# EasyEDA Pro project Archive.eprj, board ALU4.0 (continued)
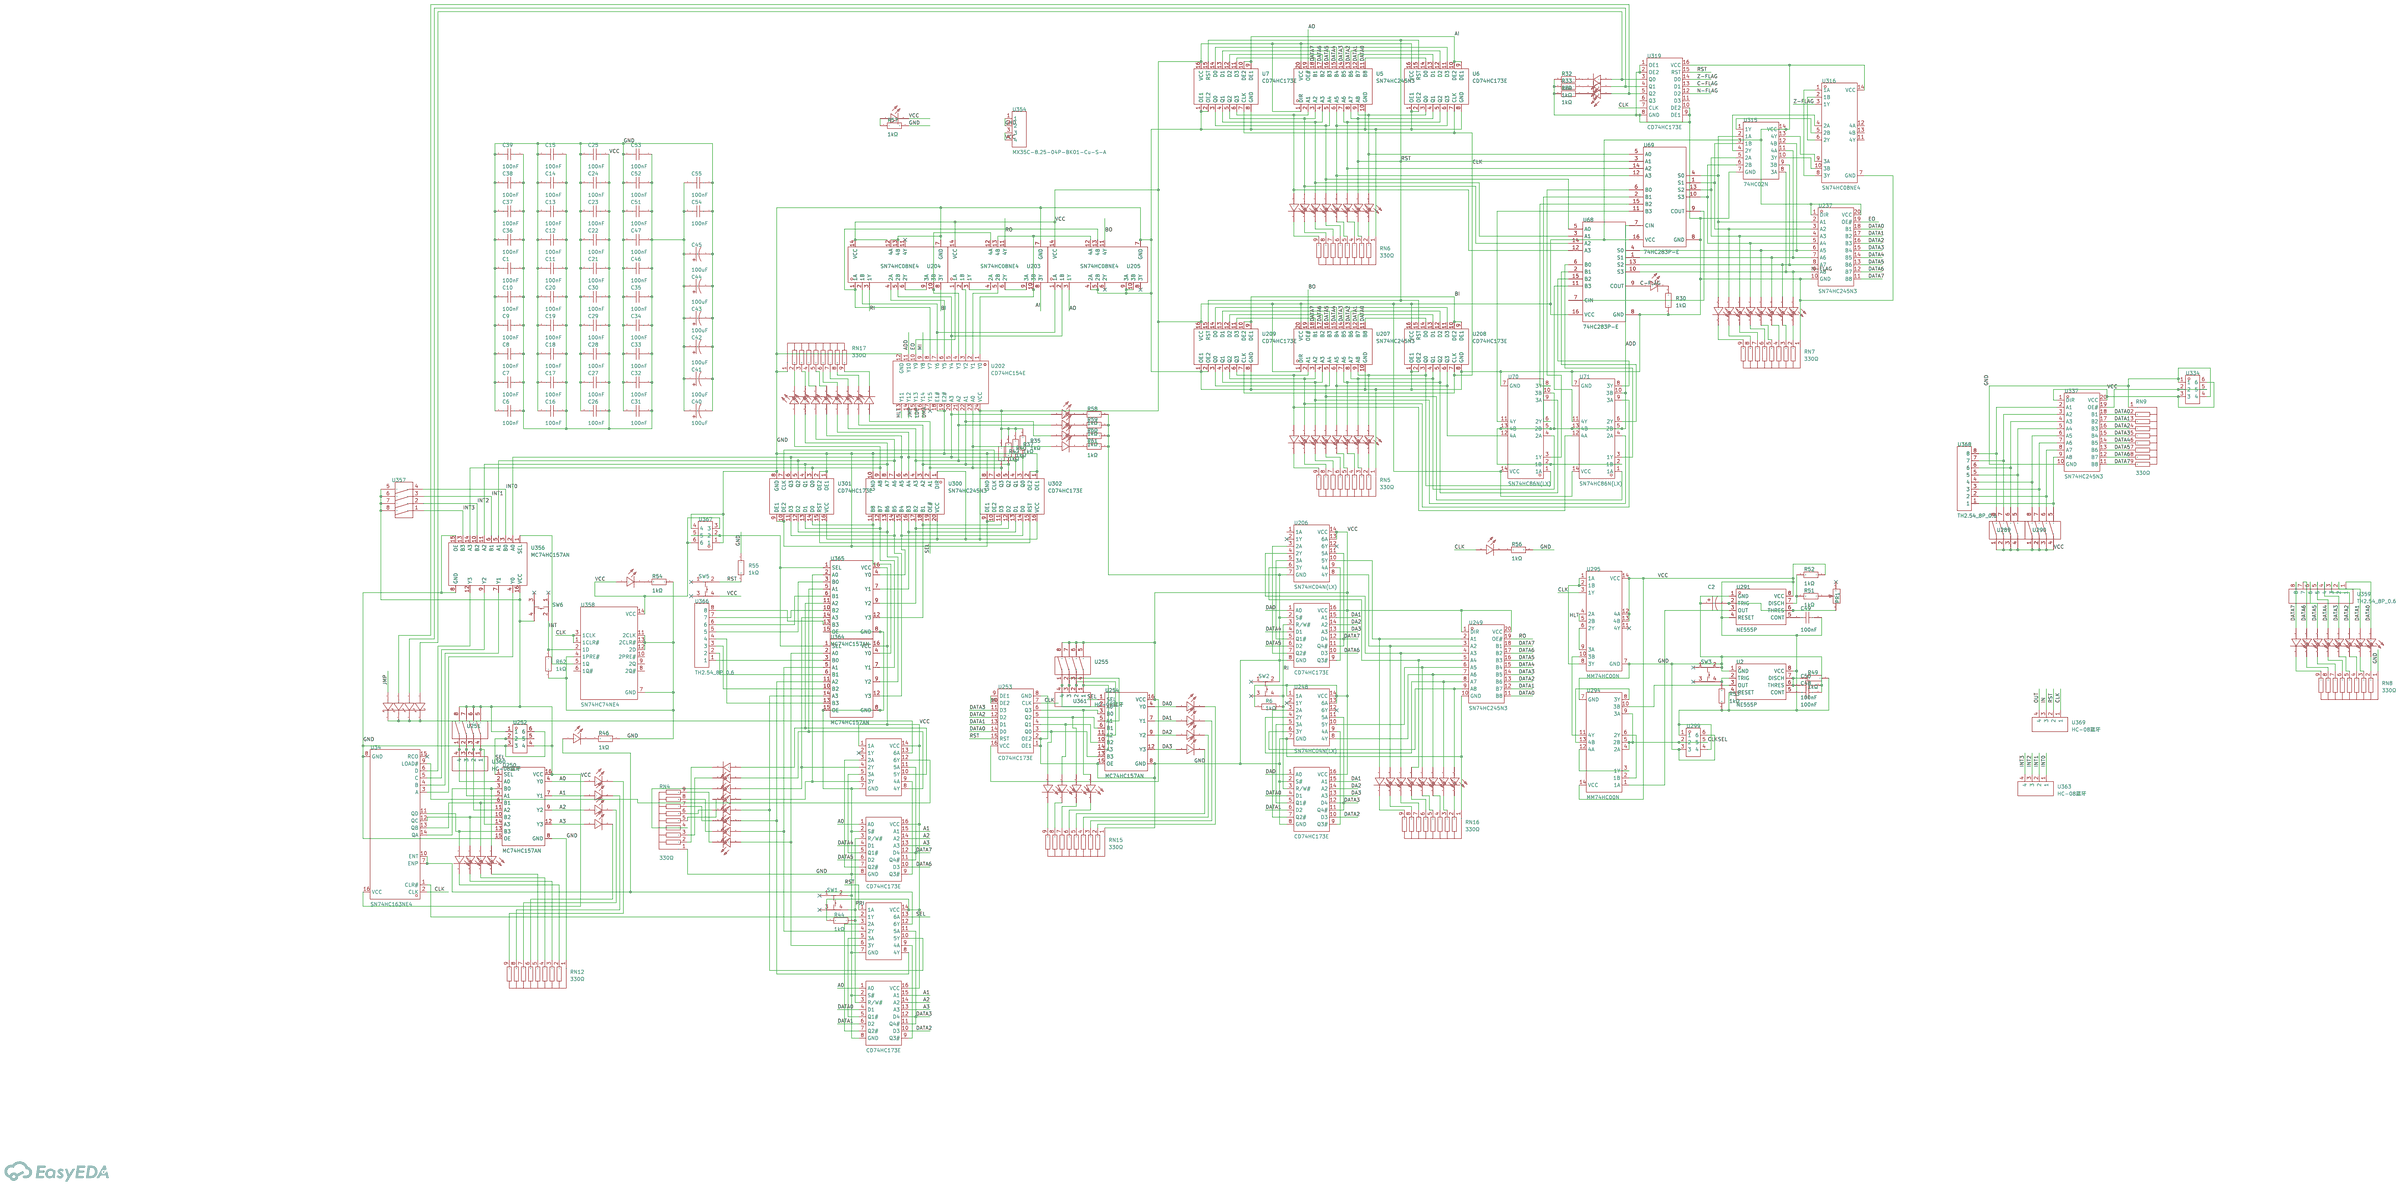
[diagram p0: schematic sheet]
## Footprints (pads in the part's own frame, mm; a bottom-side part is the same pattern mirrored in y, then rotated) (continued)
Pad_e1047
  round 1.524 hole 0.914: 1(0,0)
Pad_e1048
  round 1.524 hole 0.914: 1(0,0)
Pad_e1049
  round 1.524 hole 0.914: 1(0,0)
Pad_e1050
  round 1.524 hole 0.914: 1(0,0)
Pad_e1051
  round 1.524 hole 0.914: 1(0,0)
Pad_e1052
  round 1.524 hole 0.914: 2(0,0)
Pad_e1053
  round 1.524 hole 0.914: 1(0,0)
Pad_e1054
  round 1.524 hole 0.914: 2(0,0)
Pad_e1055
  round 1.524 hole 0.914: 2(0,0)
Pad_e1056
  round 1.524 hole 0.914: 2(0,0)
Pad_e1057
  round 1.524 hole 0.914: 2(0,0)
Pad_e1058
  round 1.524 hole 0.914: 2(0,0)
Pad_e1059
  round 1.524 hole 0.914: 2(0,0)
Pad_e1060
  round 1.524 hole 0.914: 2(0,0)
Pad_e1061
  round 1.524 hole 0.914: 2(0,0)
Pad_e1062
  round 1.524 hole 0.914: 2(0,0)
Pad_e1063
  round 1.524 hole 0.914: 2(0,0)
Pad_e1064
  round 1.524 hole 0.914: 1(0,0)
Pad_e1065
  round 1.524 hole 0.914: 1(0,0)
Pad_e1066
  round 1.524 hole 0.914: 1(0,0)
Pad_e1067
  round 1.524 hole 0.914: 1(0,0)
Pad_e1068
  round 1.524 hole 0.914: 1(0,0)
Pad_e1069
  round 1.524 hole 0.914: 1(0,0)
Pad_e1070
  round 1.524 hole 0.914: 1(0,0)
Pad_e1071
  round 1.524 hole 0.914: 1(0,0)
Pad_e1072
  round 1.524 hole 0.914: 2(0,0)
Pad_e1073
  round 1.524 hole 0.914: 2(0,0)
Pad_e1074
  round 1.524 hole 0.914: 2(0,0)
Pad_e1075
  round 1.524 hole 0.914: 1(0,0)
Pad_e1076
  round 1.524 hole 0.914: 1(0,0)
Pad_e1079
  round 1.524 hole 0.914: 1(0,0)
Pad_e1080
  round 1.524 hole 0.914: 1(0,0)
Pad_e1081
  round 1.524 hole 0.914: 1(0,0)
Pad_e1082
  round 1.524 hole 0.914: 2(0,0)
Pad_e1083
  round 1.524 hole 0.914: 2(0,0)
PDIP-16_L19.3-W6.4-P2.54-LS7.94-BL
  oval 1.44x1.8 hole 0.8: 1(-8.89,-3.97) 2(-6.35,-3.97) 3(-3.81,-3.97) 4(-1.27,-3.97) 5(1.27,-3.97) 6(3.81,-3.97) 7(6.35,-3.97) 8(8.89,-3.97) 9(8.89,3.97) 10(6.35,3.97) 11(3.81,3.97) 12(1.27,3.97) 13(-1.27,3.97) 14(-3.81,3.97) 15(-6.35,3.97) 16(-8.89,3.97)
RES-ARRAY-TH_9P-P2.54-D1.0
  rect 1.6x1.6 hole 1: 1(-10.16,0)
  round 1.6 hole 1: 2(-7.62,0) 3(-5.08,0) 4(-2.54,0) 5(0,0) 6(2.54,0) 7(5.08,0) 8(7.62,0) 9(10.16,0)
RES-TH_BD2.7-L8.8-P12.80-D0.5
  round 1.4 hole 0.7: 1(-6.4,0) 2(6.4,0)

## Nets

Pads without a net: NOREF 2; NOREF#2 13; NOREF#3 1; NOREF#4 18; NOREF#5 1; NOREF#6 1; NOREF#7 1; NOREF#8 1; NOREF#9 1; NOREF#10 2; NOREF#11 1; NOREF#12 21; NOREF#13 2; NOREF#14 1; NOREF#15 10; NOREF#16 1; NOREF#17 1; NOREF#18 2; NOREF#19 19; NOREF#20 2; NOREF#21 3; NOREF#22 2; NOREF#23 2; NOREF#24 2; NOREF#25 2; NOREF#26 2; NOREF#27 1; NOREF#28 7; NOREF#29 2; NOREF#30 1; NOREF#31 1; NOREF#32 2; NOREF#33 1; NOREF#34 6; NOREF#35 2; NOREF#36 1; NOREF#37 1; NOREF#38 1; NOREF#39 17; NOREF#40 2; NOREF#41 1; NOREF#42 22; NOREF#43 2; NOREF#44 8; NOREF#45 2; NOREF#46 1; NOREF#47 2; NOREF#48 2; NOREF#49 2; NOREF#50 1; NOREF#51 1; NOREF#52 20; NOREF#53 2; NOREF#54 2; NOREF#55 11; NOREF#56 9; NOREF#57 12; NOREF#58 14; NOREF#59 4; NOREF#60 1; NOREF#61 1; NOREF#62 16; NOREF#63 15; NOREF#64 2; NOREF#65 5; NOREF#66 2; RN1 1 2 3 4 5 6 7 8 9; RN1#2 1 2 3 4 5 6 7 8 9; U9 1 2; U14 1 2; U14#2 1 2; U14#3 1 2; U14#4 1 2; U14#5 1 2; U14#6 1 2; U14#7 1 2; U14#8 1 2; U14#9 1 2; U14#10 1 2; U14#11 1 2; U14#12 1 2; U14#13 1 2; U14#14 1 2; U14#15 1 2; U14#16 1 2; U14#17 1 2; U15 1 2 3 4 5 6 7 8 9 10 11 12 13 14 15 16 17 18 19 20; U15#2 1 2 3 4 5 6 7 8 9 10 11 12 13 14 15 16 17 18 19 20; U16 1 2 3 4 5 6 7 8 9 10 11 12 13 14 15 16; U16#2 1 2 3 4 5 6 7 8 9 10 11 12 13 14 15 16; U16#3 1 2 3 4 5 6 7 8 9 10 11 12 13 14 15 16; U16#4 1 2 3 4 5 6 7 8 9 10 11 12 13 14 15 16; U17 1 2 3 4 5 6 7 8 9 10 11 12 13 14; U17#2 1 2 3 4 5 6 7 8 9 10 11 12 13 14; U17#3 1 2 3 4 5 6 7 8 9 10 11 12 13 14; U17#4 1 2 3 4 5 6 7 8 9 10 11 12 13 14; U18 1 2 3 4 5 6 7 8 9 10 11 12 13 14 15 16; U18#2 1 2 3 4 5 6 7 8 9 10 11 12 13 14 15 16; U18#3 1 2 3 4 5 6 7 8 9 10 11 12 13 14 15 16; U18#4 1 2 3 4 5 6 7 8 9 10 11 12 13 14 15 16; U18#5 1 2 3 4 5 6 7 8 9 10 11 12 13 14 15 16; U18#6 1 2 3 4 5 6 7 8 9 10 11 12 13 14 15 16; U18#7 1 2 3 4 5 6 7 8 9 10 11 12 13 14 15 16; U18#8 1 2 3 4 5 6 7 8 9 10 11 12 13 14 15 16; U19 1 2 3 4 5 6 7 8 9 10 11 12 13 14 15 16; U19#2 1 2 3 4 5 6 7 8 9 10 11 12 13 14 15 16; U19#3 1 2 3 4 5 6 7 8 9 10 11 12 13 14 15 16; U19#4 1 2 3 4 5 6 7 8 9 10 11 12 13 14 15 16

## Via types
v1: diameter 0.61, hole 0.305, Top Layer to Bottom Layer, 13 vias

## Routing (per net, layer and track width the routed paths; a pad name or vN(x,y) marks a point on that pad's centre or on a via; arc(x,y) is an arc through that point)
(no net): length 10076.2
  Top Layer w0.254: NOREF#65.5 73.35,2.6 35.87,2.6 33.84,4.63 33.84,9.49 U15#2.15 ; U14#8.2 49.62,102.16 9.84,102.16 RN1.2 ; 44.14,28.14 45.41,29.41 45.41,36.53 44.53,37.41 44.53,61.41 44.14,61.79 ; U14#13.2 27.92,105.47 3.49,105.47 RN1.7 ; U15#2.17 38.92,9.49 38.92,4.38 39.94,3.36 69.03,3.36 NOREF#28.7 ; U16#2.10 65.96,27.29 69.93,23.32 81.23,23.32 U15.6 ; NOREF#56.9 71.59,11 U15.11 ; U17#4.4 18.62,53.29 18.62,78.42 U18#8.7 ; 54.45,35.76 48.08,29.4 48.08,27.13 43.64,22.68 41.47,22.68 U15#2.4 ; NOREF#15.10 70.3,12.25 77.06,12.25 U15.12 ; 46.81,84.66 45.8,83.64 45.8,57.61 47.95,55.45 50.75,55.45 U17#3.1 ; U15.15 83.15,13.77 64.21,13.77 NOREF#2.13 ; 12.39,28.14 12.39,27.25 16.33,23.32 27.63,23.32 U15#2.6 ; NOREF#45.2 79.83,1.45 33.2,1.45 24.71,9.95 U15#2.12 ; 102.56,69.41 108.91,75.76 108.91,80.97 105.23,84.66 ; U15#2.5 39.56,23.32 43.38,23.32 45.54,25.48 45.54,28.65 46.83,29.94 46.83,35.76 ; U15#2.16 36.25,9.61 36.25,4.76 38.03,2.98 71.19,2.98 NOREF#34.6 ; U15.13 79.09,12.76 68.27,12.76 NOREF#55.11 ; 73.74,84.66 72.7,83.62 72.7,72.8 72.47,72.56 72.47,57.61 74.62,55.45 77.42,55.45 U17#2.1 ; RN1.9 18.65,112.07 U14#15.2 ; 25.22,84.66 28.9,80.97 28.9,75.76 22.55,69.41 ; 70.81,61.79 71.2,61.41 71.2,37.41 72.08,36.53 72.08,29.41 70.81,28.14 ; NOREF#59.4 75.51,2.22 33.46,2.22 29.79,5.89 U15#2.14 ; 39.19,84.66 45.29,78.56 45.29,53.29 U17#3.4 ; NOREF#44.8 66.88,3.74 42.35,3.74 41.46,4.63 41.46,9.49 U15#2.18 ; 65.86,84.66 72.32,78.2 72.32,73.22 72.07,72.97 72.07,53.18 U17#2.4 ; 51.89,84.66 55.57,80.97 55.57,75.41 U18#3.3 ; RN1.5 4.12,104.07 36.53,104.07 U14#11.2 ; RN1.3 7.93,102.8 45.17,102.8 U14#9.2 ; U15.14 81.12,13.26 66.24,13.26 NOREF#57.12 ; U17.4 98.63,53.29 98.63,78.56 92.53,84.66 ; 20.14,84.66 20.07,84.59 ; U14#14.2 25.34,107.88 3.61,107.88 RN1.8 ; U17.1 104.09,55.45 101.29,55.45 99.14,57.61 99.14,83.64 100.15,84.66 ; 17.47,61.79 17.86,61.41 17.86,37.41 18.74,36.53 18.74,29.41 17.47,28.14 ; NOREF#63.15 60.14,14.79 87.22,14.79 U15.17 ; U14#12.2 32.29,104.83 2.34,104.83 RN1.6 ; 97.48,61.79 97.87,61.41 97.87,38.39 99.24,37.01 99.24,29.9 97.48,28.14 ; U18#2.3 82.24,75.28 82.24,80.97 78.56,84.66 ; U15.16 85.18,14.28 62.18,14.28 NOREF#58.14 ; U15#2.11 32.09,1.07 82.04,1.07 NOREF#5.1 ; U18#8.4 18.98,83.37 18.98,57.75 21.28,55.45 24.08,55.45 U17#4.1 ; 108.05,35.76 101.68,29.4 101.68,27.13 97.24,22.68 95.07,22.68 U15.4 ; U15#2.13 27.25,7.92 33.33,1.84 77.67,1.84 NOREF#21.3 ; U16.4 100.38,29.89 99.14,28.65 99.14,25.48 96.98,23.32 93.17,23.32 U15.5 ; U14#10.2 40.89,103.44 6.03,103.44 RN1.4 ; 12.52,84.66 12.58,84.6 ; U15.18 89.25,15.3 58.11,15.3 NOREF#62.16
  Top Layer w0.7: NOREF#50.1 12.78,44.45 12.78,51.51 U17#4.7 ; NOREF#39.17 45.27,5.04 v1(60.87,20.65) 60.87,33.54 U16#2.8 67.24,32.27 67.24,27.43 NOREF#33.1 ; U19.8 13.79,96.39 13.79,91.55 NOREF#36.1 ; U18.8 94.06,65.32 94.06,61.06 NOREF#6.1 ; 90.22,69.41 90.35,69.28 ; NOREF#17.1 40.44,61.08 40.44,65.33 U18#3.8 ; NOREF#27.1 13.8,76.44 13.8,80.7 U18#8.8 ; U15.1 U15.20 ; 70.13,73.71 69.96,73.71 67.39,76.28 67.39,80.71 U18#5.8 ; NOREF#37.1 67.24,61.08 67.24,65.33 U18#2.8 ; 70.12,88.95 69.94,88.95 67.37,91.52 67.37,96.41 U19#3.8 ; U17#3.7 39.45,51.51 39.45,44.45 NOREF#51.1 ; U18#4.8 13.65,65.32 13.65,61.06 NOREF#41.1 ; NOREF#16.1 43.16,73.71 40.59,76.28 40.59,80.71 U18#7.8 ; NOREF#46.1 40.58,91.56 40.58,96.4 36.76,100.22 ; NOREF#38.1 94.06,27.41 94.06,32.25 U16.8 ; U17#2.7 66.12,51.51 66.12,44.45 NOREF#30.1 ; U16#3.8 36.62,35.8 40.44,31.99 40.44,27.43 NOREF#8.1 ; NOREF#9.1 94.18,91.56 94.18,96.4 U19#4.8 ; U18#6.8 94.18,80.71 94.18,76.4 96.75,73.83 96.93,73.83 ; NOREF#11.1 92.79,44.45 92.79,51.51 U17.7 ; U16#4.8 13.65,32.25 13.65,27.42 NOREF#60.1 ; 63.57,69.3 63.42,69.45 ; U15#2.1 U15#2.20 ; 36.77,69.3 36.62,69.45 ; NOREF#40.2 arc(104.09,42.62) U17.14 ; NOREF#18.2 arc(78.68,89.74) U19#3.16 ; NOREF#29.2 arc(77.42,42.62) U17#2.14 ; NOREF#35.2 arc(51.74,25.61) U16#3.16 ; NOREF#32.2 arc(78.69,74.63) U18#5.16 ; NOREF#10.2 arc(78.54,59.25) U18#2.16 ; NOREF#13.2 arc(51.88,89.74) U19#2.16 ; NOREF.2 arc(24.08,42.62) U17#4.14 ; NOREF#22.2 arc(51.89,74.63) U18#7.16 ; NOREF#49.2 arc(50.75,42.62) U17#3.14 ; NOREF#47.2 arc(105.34,25.61) U16.16 ; NOREF#48.2 arc(105.48,89.74) U19#4.16 ; NOREF#25.2 arc(78.54,25.61) U16#2.16 ; NOREF#20.2 arc(25.08,89.74) U19.16 ; NOREF#64.2 arc(25.09,74.63) U18#8.16 ; NOREF#53.2 arc(105.34,59.26) U18.16 ; NOREF#54.2 arc(24.94,25.61) U16#4.16 ; NOREF#23.2 arc(51.74,59.25) U18#3.16 ; NOREF#24.2 arc(105.49,74.63) U18#6.16 ; NOREF#43.2 arc(24.94,59.25) U18#4.16
  Top Layer w1: 101.59,106.59 104.34,106.59 110.04,100.9 110.04,35.62 v1(106.86,32.44) ; 4.38,74.59 U18#4.8 ; 4.38,74.59 4.38,78.93 ; 4.38,74.59 4.38,45.65 ; 4.38,89.34 RN1.1 ; 4.38,89.34 4.38,94.63 U19.8 ; 4.38,89.34 4.38,78.93 ; U19#4.1 U19#4.2 ; U19#2.1 U19#2.2 ; 4.38,45.65 4.38,27.87 13.63,18.62 U15#2.10 ; 4.38,45.65 U17#4.7 ; U19.10 U19.9 ; U19#3.10 U19#3.9 ; U19#3.1 U19#3.2 ; U19#4.10 U19#4.9 ; 4.38,78.93 U18#8.8 ; U19.1 25.2,100.22 ; U19#2.10 36.76,92.28
  Inner1 w0.254: U15.6 87.26,19.95 87.26,99.12 79.78,106.59 76.59,106.59 ; v1(17.92,34.05) 18.74,34.87 18.74,42.37 20.27,43.89 20.27,51.38 U17#4.3 ; U19#2.3 50.75,98.93 50.75,85.93 52.02,84.66 ; 73.81,77.04 73.81,71.96 74.83,70.94 74.83,63.19 76.22,61.79 ; U19#3.6 70.36,101.93 78.94,101.93 80.09,100.79 80.09,80.97 76.28,77.17 ; 86.59,106.59 88.27,104.91 88.27,21.35 U15.4 ; 51.5,106.59 48.85,103.94 38.16,103.94 31.93,97.72 31.93,26.63 U15#2.3 ; U19#4.6 97.16,101.93 105.74,101.93 106.88,100.79 106.88,80.97 U18#6.14 ; 71.09,36.04 70.81,35.76 ; U18#3.2 51.86,72.64 48.22,76.28 48.22,83.39 49.49,84.66 ; U19#2.4 45.67,98.96 45.67,85.93 44.4,84.66 ; 89.86,61.79 89.86,43.85 96.58,37.14 96.58,34.13 102.56,28.14 ; 103.05,84.66 101.78,83.39 101.78,76.28 105.46,72.59 U18.2 ; U16#2.5 71.04,59.1 72.21,60.27 72.21,67.78 U18#2.4 ; U18#2.5 72.41,70.52 72.41,80.97 68.73,84.66 ; U18#6.11 94.18,78.44 94.18,87.96 96.85,90.63 96.85,99.08 U19#4.5 ; 71.59,106.59 73.35,104.83 79.76,104.83 86.75,97.85 86.75,21.98 U15.7 ; U18#3.5 45.56,70.47 45.56,80.97 41.87,84.66 ; 14.93,61.79 13.66,63.06 13.66,75.89 12.52,77.04 ; U18#3.4 45.54,67.91 45.54,59.51 44.53,58.5 44.53,36.14 44.14,35.76 ; 73.62,35.76 77.3,32.08 77.3,19.63 U15.9 v1(81.34,21.65) ; U19#4.3 104.34,98.94 104.34,86.06 105.61,84.78 ; U19#3.3 77.55,98.94 77.55,86.06 78.82,84.78 ; U18.5 99.11,70.42 99.11,80.97 95.43,84.66 ; 22.61,84.59 22.68,84.66 ; U15#2.9 23.7,19.63 23.7,32.08 20.01,35.76 ; 49.22,28.14 43,34.37 43,36.65 36.52,43.13 36.52,61.79 ; 63.19,61.79 63.19,43.13 69.67,36.65 69.67,34.59 U16#2.14 ; 49.37,61.79 47.97,63.19 47.97,70.94 46.95,71.96 46.95,77.04 ; U16#2.1 82.61,34.68 82.61,20.38 ; U18.11 94.03,63.06 94.03,75.89 92.89,77.04 ; U18#2.2 78.66,72.69 75.08,76.28 75.08,83.39 76.35,84.66 ; U18#4.4 18.87,68.04 18.87,59.51 17.86,58.5 17.86,36.5 U16#4.5 ; 97.99,84.78 99.26,86.06 99.26,98.96 U19#4.4 ; v1(71.26,34.05) 72.08,34.87 72.08,42.37 73.61,43.89 73.61,51.38 U17#2.3 ; 82.61,20.38 U15.8 ; 82.61,20.38 86.24,24.01 86.24,97.72 80.02,103.94 69.32,103.94 66.67,106.59 ; U15#2.5 30.92,22.57 30.92,99.12 38.39,106.59 41.59,106.59 ; 68.6,61.79 67.33,63.06 67.33,75.89 66.19,77.04 ; U16.5 97.84,58.47 98.88,59.51 98.88,67.65 U18.4 ; U18#8.6 18.74,80.83 18.74,70.46 U18#4.5 ; U18#8.2 23.95,85.78 23.95,98.93 U19.3 ; U15.5 87.76,19.32 87.76,100.41 81.59,106.59 ; U15.3 88.78,23.38 88.78,103.78 91.59,106.59 ; 22.68,77.04 26.49,80.85 26.49,100.66 25.35,101.8 16.63,101.8 15.04,100.22 ; 22.55,28.14 16.33,34.37 16.33,36.65 9.85,43.13 9.85,61.79 ; 61.59,106.59 65.25,102.93 80.27,102.93 85.73,97.47 85.73,26.04 v1(83.37,23.68) ; v1(44.59,34.05) 45.41,34.87 45.41,42.37 46.94,43.89 46.94,51.38 U17#3.3 ; 68.66,77.17 67.39,78.44 67.39,87.96 70.05,90.63 70.05,99.09 U19#3.5 ; U18#8.3 21.41,83.27 21.41,76.28 25.06,72.63 U18#4.2 ; U19#2.6 43.43,101.8 52.15,101.8 53.29,100.66 53.29,80.85 49.48,77.04 ; U15#2.6 30.41,20.53 30.41,100.41 36.59,106.59 ; 20.14,77.04 20.14,71.96 21.16,70.94 21.16,63.19 22.55,61.79 ; U15#2.8 28.65,20.02 28.65,35.03 U16#4.1 29.39,37.88 29.39,103.78 26.59,106.59 ; 100.51,77.04 100.51,71.96 101.52,70.94 101.52,63.19 U18.14 ; 41.75,61.79 40.48,63.06 40.48,75.89 39.33,77.04 ; 92.81,21.9 U15.2 ; 92.81,21.9 89.21,25.49 89.21,100.69 95.11,106.59 96.59,106.59 ; 92.81,21.9 92.81,28.14 ; v1(97.93,34.3) 99.12,35.49 99.12,42.73 100.28,43.89 100.28,51.38 U17.3 ; 15.12,84.6 15.06,84.66 ; 71.2,84.78 72.47,86.06 72.47,98.96 U19#3.4 ; 31.59,106.59 29.9,104.91 29.9,18.73 U15#2.7 ; U16#4.4 28.89,44.99 28.89,100.77 23.06,106.59 21.59,106.59 ; 39.21,21.9 32.44,28.66 32.44,97.47 37.9,102.93 52.92,102.93 56.59,106.59 ; 39.21,21.9 U15#2.2 ; 39.21,21.9 39.21,28.14 ; U15#2.4 31.43,24.6 31.43,97.85 38.41,104.83 44.83,104.83 46.59,106.59 ; U19.5 16.46,99.09 16.46,90.5 13.79,87.83 13.79,78.31 15.06,77.04 ; 44.38,100.22 43.26,99.09 43.26,90.5 40.59,87.83 40.59,78.31 41.86,77.04 ; 20.12,100.22 18.87,98.97 18.87,85.81 U18#8.5
  Inner1 w0.5: U16#4.7 13.65,34.8 13.65,17.07 22.41,8.31 31.79,8.31 NOREF#12.21
  Inner1 w1: U19.7 8.06,95.77 8.06,19.62 24.57,3.1 38.3,3.1 NOREF#19.19
  Inner2 w0.254: 25.09,35.76 23.95,34.62 21.91,34.62 21.29,35.24 21.29,36.48 17.25,40.53 17.25,49.22 13.69,52.78 ; 51.91,35.76 50.76,34.62 48.72,34.62 48.1,35.24 48.1,36 44.06,40.04 44.06,49.22 40.5,52.78 ; v1(81.34,21.65) v1(83.37,23.68) ; U17.12 100.41,46.43 100.41,53.8 98.88,55.32 98.88,75.77 97.61,77.04 ; 68.73,77.04 68.74,77.03 ; 68.74,77.03 68.74,77.15 68.75,77.17 ; 68.74,77.03 68.74,72.95 69.75,71.94 69.75,65.48 66.06,61.79 ; U17#2.12 73.74,46.43 73.74,53.8 72.21,55.32 72.21,75.77 70.94,77.04 ; 40.84,45.16 35.51,50.5 35.51,75.77 36.78,77.04 ; 20.01,61.79 23.82,65.6 23.82,75.89 22.68,77.04 ; U16#2.3 71.32,40.88 71.32,54.56 64.59,61.29 64.59,67.78 U18#2.7 ; 25.09,61.79 26.36,63.06 26.36,75.89 25.22,77.04 ; U14#6.2 74.86,105.86 74.86,99.6 76.1,98.35 110.67,98.35 RN1#2.4 ; U18#4.7 11.25,68.04 11.25,61.29 17.98,54.56 17.98,40.62 U16#4.3 ; U15.12 82.23,14.92 82.73,14.92 84.77,16.95 84.77,83.88 78.67,89.97 73.49,89.97 U19#3.12 ; v1(21.63,31.38) 22.9,31.38 26.12,34.6 26.12,37.81 18.77,45.16 ; U14#5.2 83.93,101.78 RN1#2.5 ; 20.01,28.14 29.54,18.62 U15#2.7 ; 41.9,77.17 41.88,77.15 41.88,72.95 42.9,71.94 42.9,65.48 39.21,61.79 ; U18#6.9 89.1,75.89 89.1,50.62 94.44,45.29 ; 67.36,52.78 70.91,49.22 70.91,40.45 74.86,36.51 74.86,35.33 75.57,34.62 77.2,34.62 U16#2.2 ; U15.15 89.47,14.53 89.47,19.23 85.91,22.79 85.91,82.74 U19#4.11 ; 71.27,84.66 67.37,80.76 67.37,70.28 U18#2.6 ; U15#2.13 33.32,17.07 33.32,19.62 31.55,21.39 31.55,84.13 25.07,90.61 21.79,90.61 20.12,92.28 ; U15#2.15 35.86,14.53 35.86,19.23 32.31,22.79 32.31,82.74 U19#2.11 ; 15.04,92.28 19.89,87.43 26.97,87.43 30.78,83.62 30.78,17.58 28.12,14.92 26.08,14.92 U15#2.11 ; 15.09,77.17 15.07,77.15 15.07,72.95 16.08,71.94 16.08,65.48 12.39,61.79 ; 100.43,28.14 100.43,25.5 U15.3 ; 49.49,77.04 50.64,75.89 50.64,65.6 46.83,61.79 ; U14#4.2 86.39,104.32 RN1#2.6 ; U16#4.6 16.93,34.05 v1(17.92,34.05) ; U17.6 97.61,49.22 97.61,40.68 101.66,36.63 101.66,35.24 102.27,34.62 104,34.62 U16.2 ; v1(97.93,34.3) 97.08,34.3 U16.6 ; 51.91,28.14 49.49,30.56 45.5,30.56 40.6,35.45 40.6,42.88 38.32,45.16 ; U18#3.7 37.92,67.91 37.92,61.29 44.65,54.56 44.65,40.33 49.22,35.76 ; 67.64,45.16 62.31,50.5 62.31,75.77 63.58,77.04 ; v1(44.59,34.05) 43.32,34.05 41.6,35.76 ; U17#4.12 20.4,46.43 20.4,53.8 18.87,55.32 18.87,75.77 17.6,77.04 ; 91.87,45.16 94.16,42.88 94.16,35.45 99.06,30.56 103.05,30.56 U16.15 ; U17#4.8 13.79,42.88 13.79,35.45 18.69,30.56 22.68,30.56 25.09,28.14 ; 64.83,45.14 67.24,42.73 67.24,35.67 72.36,30.56 76.35,30.56 78.76,28.14 ; U19#4.14 97.2,86.42 95.56,86.42 94.24,85.09 94.24,84.59 87.05,77.4 87.05,25.08 92.51,19.62 92.51,12.03 U15.18 ; U18#3.6 40.7,70.15 40.7,80.94 44.41,84.66 ; U15#2.18 38.91,12.03 38.91,19.62 33.45,25.08 33.45,77.4 40.64,84.59 40.64,85.34 41.71,86.42 43.6,86.42 U19#2.14 ; 17.6,84.66 17.53,84.59 ; 73.68,61.79 77.49,65.6 77.49,75.89 76.35,77.04 ; U19#2.13 45.13,90.48 43.48,90.48 38.15,85.15 38.15,84.64 33.07,79.56 33.07,24.69 38.4,19.36 38.4,12 U15#2.17 ; U14#16.2 64.83,105.89 64.83,99.24 69.91,94.16 RN1#2.2 ; U15.11 79.69,14.92 81.72,14.92 84.38,17.58 84.38,83.62 80.57,87.43 73.49,87.43 U19#3.11 67.49,93.43 ; U19.12 19.89,89.97 25.07,89.97 31.16,83.88 31.16,16.95 29.13,14.92 28.62,14.92 U15#2.12 ; U14#2.2 92.97,107.75 109.91,107.75 RN1#2.8 ; 44.27,77.04 45.54,75.77 45.54,55.32 47.07,53.8 47.07,46.43 U17#3.12 ; v1(48.44,31.38) 49.71,31.38 52.93,34.6 52.93,37.81 45.58,45.16 ; RN1#2.7 109.53,104.83 90.89,104.83 U14#3.2 ; U19#3.13 75.39,90.61 78.67,90.61 85.15,84.13 85.15,21.39 86.93,19.62 86.93,17.07 U15.13 ; U19#4.12 91.74,86.04 89.97,86.04 86.29,82.35 86.29,23.17 89.97,19.49 89.97,12.5 U15.16 ; RN1#2.9 99.4,111.94 U14.2 ; U9.2 112.83,89.77 112.83,110.17 112.32,110.67 103.13,110.67 U14#17.2 ; v1(71.26,34.05) 70.53,34.05 U16#2.6 ; U18.13 104.19,65.6 104.19,75.89 103.05,77.04 ; U15.14 87.31,14.92 87.31,20.04 85.53,21.81 85.53,84.39 78.8,91.11 77.43,91.11 U19#3.14 ; U17#4.9 8.71,50.5 8.71,75.77 9.98,77.04 ; U15#2.16 36.37,12.5 36.37,19.49 32.69,23.17 32.69,82.35 36.37,86.04 38.14,86.04 44.38,92.28 ; U15#2.14 33.7,14.92 33.7,20.04 31.93,21.81 31.93,84.39 25.2,91.11 23.83,91.11 U19.14 ; 72.44,45.16 79.78,37.81 79.78,34.6 76.56,31.38 v1(75.29,31.38) ; RN1#2.3 72.45,96.7 69.91,99.24 69.91,105.81 U14#7.2 ; U15.7 83.14,18.62 73.62,28.14 ; v1(101.99,31.38) 103.26,31.38 106.48,34.6 106.48,37.81 U17.11 ; U18#6.11 95.43,77.15 95.43,72.95 96.45,71.94 96.45,65.48 U18.10 ; U19#4.13 98.73,90.48 97.09,90.48 91.75,85.15 91.75,84.64 86.67,79.56 86.67,24.69 92,19.36 92,12 U15.17 ; U18.7 91.26,67.65 91.26,61.29 97.99,54.56 97.99,41.01 U16.3 ; U18#4.6 13.9,70.15 13.9,80.83 U18#8.5 ; 97.97,84.66 94.29,80.98 94.29,70.16 U18.6 ; 46.83,28.14 46.83,25.5 U15#2.3
  Inner2 w1: v1(6.41,63.43) 6.41,24.19 25.6,4.99 NOREF#42.22
  Bottom Layer w0.254: U16#2.9 67.36,32.08 88.76,32.08 U16.7 ; U17#3.10 U17#3.7 39.57,51.38 41.86,51.38 ; 52.02,76.91 54.05,78.94 76.91,78.94 78.82,77.04 80.85,79.07 103.71,79.07 U18#6.15 ; U17#2.13 71.32,51.38 ; 71.32,51.38 76.15,51.38 U17#2.2 ; 71.32,51.38 68.53,51.38 ; U15.19 94.84,12.25 43.74,12.25 U15#2.19 NOREF#52.20 ; U17#4.2 22.81,51.38 17.98,51.38 ; U16.9 94.52,32.44 v1(106.86,32.44) ; U17#4.5 15.19,51.38 ; 15.19,51.38 12.9,51.38 U17#4.7 U17#4.10 ; 15.19,51.38 17.98,51.38 ; 95.2,51.38 92.91,51.38 U17.7 U17.10 ; 95.2,51.38 97.99,51.38 ; 95.2,51.38 U17.5 ; 14.93,28.14 18.17,31.38 v1(21.63,31.38) ; U17.13 97.99,51.38 ; 97.99,51.38 102.82,51.38 U17.2 ; 41.86,51.38 44.65,51.38 ; 41.86,51.38 U17#3.5 ; 39.21,35.76 35.52,32.08 13.79,32.08 9.85,28.14 ; 68.53,51.38 66.24,51.38 U17#2.7 U17#2.10 ; 68.53,51.38 U17#2.5 ; U18#4.1 29.37,67.38 52.63,67.38 U18#3.1 56.04,67.51 79.56,67.51 U18#2.1 82.84,67.51 106.36,67.51 U18.1 ; U16.11 98.54,31.38 v1(101.99,31.38) ; U17#3.13 44.65,51.38 ; 44.65,51.38 49.48,51.38 U17#3.2 ; v1(48.44,31.38) 44.99,31.38 41.75,28.14 ; U16#2.7 61.96,32.08 40.6,32.08 36.67,28.14 ; U16#2.11 71.74,31.38 v1(75.29,31.38) ; 25.17,61.67 27.2,63.7 50.06,63.7 51.97,61.79 ; 17.98,51.38 U17#4.13 ; 52.02,77.04 50.11,78.94 27.25,78.94 25.22,76.91 ; 51.97,61.66 54,63.7 76.86,63.7 78.76,61.79 80.79,63.82 103.65,63.82 105.56,61.92
  Bottom Layer w0.7: 52.4,26.14 29.6,26.14 U16#4.16 ; 52.4,26.14 79.2,26.14 ; 52.4,26.14 U16#3.16 ; 25.09,61.79 28.95,55.45 ; 79.2,59.79 106,59.79 U18.16 ; 79.2,59.79 U18#2.16 ; 79.2,59.79 52.4,59.79 ; 34.24,38.18 11.91,38.18 U16#4.8 ; 34.24,38.18 61.33,38.18 ; 34.24,38.18 36.65,35.76 ; 87.86,102.72 78.84,102.72 ; 87.86,102.72 105.64,102.72 U19#4.1 ; 87.86,102.72 U19#4.8 ; 78.84,102.72 61.06,102.72 ; 78.84,102.72 U19#3.1 ; U19#3.9 60.56,95.28 ; 60.56,95.28 75.8,95.28 U19#3.15 81.8,95.28 87.36,95.28 ; 60.56,95.28 55,95.28 U19#2.15 49,95.28 33.76,95.28 ; U18#8.16 29.75,75.17 52.55,75.17 ; 52.4,59.79 29.6,59.79 U18#4.16 ; 52.4,59.79 U18#3.16 ; 16.57,96.34 21.14,96.34 U19.15 28.2,95.28 33.76,95.28 ; 16.57,96.34 U19.10 ; 16.57,96.34 13.84,96.34 U19.8 12.47,102.72 25.24,102.72 ; U19.7 15.33,97.39 36.48,97.39 U19#2.7 42.13,97.39 63.28,97.39 U19#3.7 69.22,97.1 89.79,97.1 U19#4.7 ; U19#2.16 52.54,90.28 ; 52.54,90.28 29.74,90.28 U19.16 ; 52.54,90.28 79.35,90.28 ; U18#4.8 12.49,71.82 33.95,71.82 ; 10,35.9 9.85,35.76 ; U19#3.16 79.35,90.28 ; 79.35,90.28 106.15,90.28 U19#4.16 ; 60.75,71.82 U18#2.8 ; 60.75,71.82 87.55,71.82 U18.8 ; 60.75,71.82 33.95,71.82 ; 62.18,55.45 U17#2.7 ; 62.18,55.45 88.85,55.45 U17.7 ; 62.18,55.45 35.51,55.45 ; U17.14 104.85,43.26 78.18,43.26 ; 45.07,10.95 NOREF#26.2 ; 52.55,75.17 79.35,75.17 ; 52.55,75.17 U18#7.16 ; 61.06,102.72 52.04,102.72 ; 61.06,102.72 U19#3.8 ; 52.04,102.72 U19#2.1 ; 52.04,102.72 34.26,102.72 ; 34.26,102.72 25.24,102.72 ; 34.26,102.72 36.76,100.22 ; 25.24,102.72 U19.1 ; 51.51,43.26 U17#3.14 ; 51.51,43.26 28.65,43.26 U17#4.14 ; 51.51,43.26 78.18,43.26 ; 61.03,87.07 87.83,87.07 U18#6.8 ; 61.03,87.07 34.22,87.07 ; 61.03,87.07 U18#5.8 ; NOREF#66.2 98.67,10.95 ; 33.95,71.82 U18#3.8 ; 33.76,95.28 36.76,92.28 ; 63.45,35.76 63.27,35.94 ; 61.33,38.18 88.13,38.18 U16.8 ; 61.33,38.18 U16#2.8 ; U16.16 106,26.14 79.2,26.14 ; 34.22,87.07 12.52,87.07 U18#8.8 ; 34.22,87.07 U18#7.8 ; 79.2,26.14 U16#2.16 ; NOREF#7.1 78.43,15.95 U15.10 73.74,20.65 v1(60.87,20.65) 24.2,20.65 U15#2.10 24.83,15.95 NOREF#14.1 ; 28.95,55.45 35.51,55.45 ; 28.95,55.45 14.17,55.45 U17#4.7 ; 87.36,95.28 102.6,95.28 U19#4.15 ; 87.36,95.28 U19#4.9 ; 78.18,43.26 U17#2.14 ; 35.51,55.45 U17#3.7 ; 79.35,75.17 106.15,75.17 U18#6.16 ; 79.35,75.17 U18#5.16
  Bottom Layer w1: 96.07,8.44 104.32,8.44 110.04,14.15 110.04,26.1 ; 96.07,8.44 47.58,8.44 ; 96.07,8.44 U15.20 ; 110.04,74.17 U9.1 ; 110.04,74.17 110.04,59.75 ; 110.04,74.17 110.04,75.28 ; U18.16 110.04,59.75 ; 110.04,59.75 110.04,41.88 ; 110.04,41.88 110.04,26.1 ; 110.04,41.88 U17.14 ; 110.04,26.1 U16.16 ; NOREF#4.18 46.17,8.44 47.58,8.44 ; v1(6.41,63.43) 9.07,66.1 24.54,66.1 U18#4.1 ; 47.58,8.44 U15#2.20 ; U19#4.16 110.04,90.38 110.04,90.1 ; U18#6.16 110.04,75.28 ; 110.04,75.28 110.04,90.1 ; 27.63,69.41 27.49,69.26 ; 110.04,90.1 RN1#2.1

## Text on the board
Bottom Silkscreen Layer: 100nF | SW | SB | WR | CLK | 5V | GND | 15 | 14 | 13 | 12 | 11 | 10 | 9 | 8 | 7 | 6 | 5 | 4 | 3 | 2 | 1 | 0 | 330Ω | BOTTOM | C | SN74HC283N | SN74HC157N | SN74HC173N | SN74HC86N | SN74HC245N
Top Silkscreen Layer: 100nF | SW | SB | WR | CLK | 5V | GND | 15 | 14 | 13 | 12 | 11 | 10 | 9 | 8 | 7 | 6 | 5 | 4 | 3 | 2 | 1 | 0 | TOP | C | 330Ω | SN74HC283N | SN74HC157N | SN74HC173N | SN74HC86N | SN74HC245N
